# EasyEDA Pro project ProProject_IMUSensorNodes202312.epro, board 6_6_拼板20240123（不带编号） (continued)
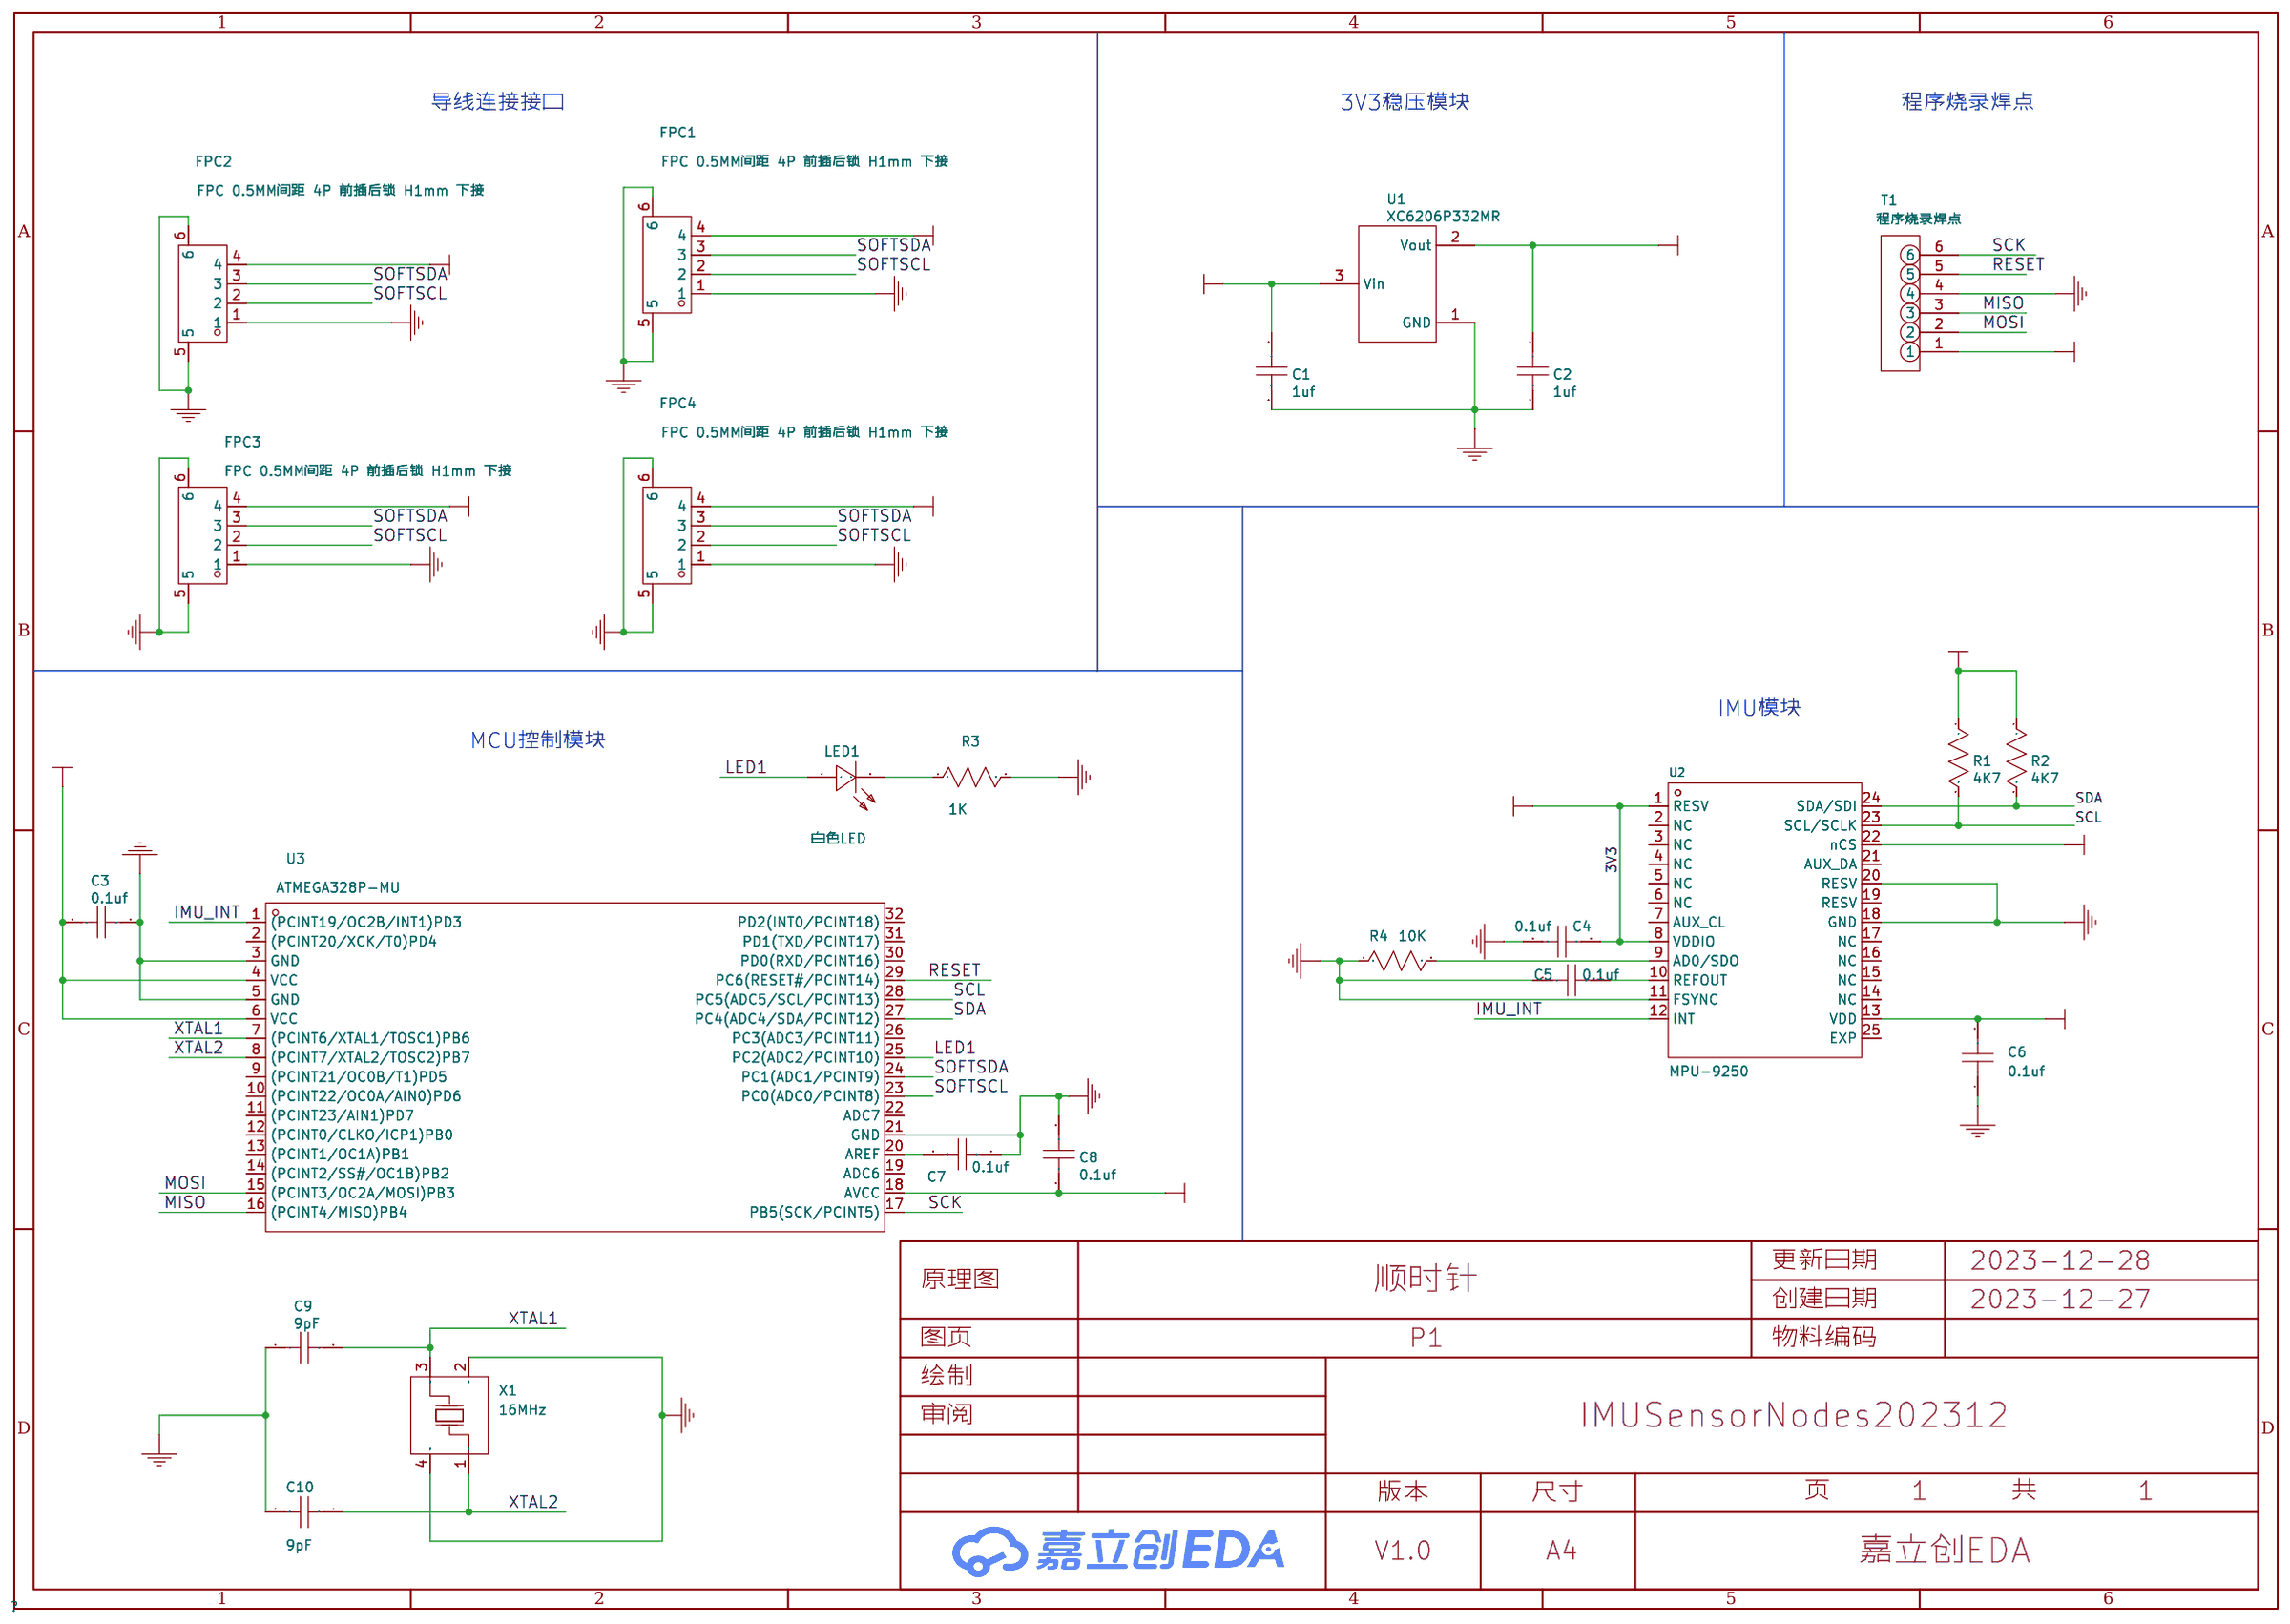
[diagram p0: schematic sheet]
## Placement (name value [footprint] x y rotation side) (continued)
FPC2#10  -  [fpc-0.5mm-4p-h1.0]  6 49.95 180 top
FPC2#11  -  [fpc-0.5mm-4p-h1.0]  60.61 77.38 180 top
FPC2#12  -  [fpc-0.5mm-4p-h1.0]  60.61 63.66 180 top
FPC2#13  -  [fpc-0.5mm-4p-h1.0]  6 36.23 180 top
FPC2#14  -  [fpc-0.5mm-4p-h1.0]  19.72 8.8 180 top
FPC2#15  -  [fpc-0.5mm-4p-h1.0]  74.33 8.8 180 top
FPC2#16  -  [fpc-0.5mm-4p-h1.0]  47.02 22.51 180 top
FPC2#17  -  [fpc-0.5mm-4p-h1.0]  19.72 36.23 180 top
FPC2#18  -  [fpc-0.5mm-4p-h1.0]  74.33 36.23 180 top
FPC2#19  -  [fpc-0.5mm-4p-h1.0]  6 63.66 180 top
FPC2#20  -  [fpc-0.5mm-4p-h1.0]  74.33 22.51 180 top
FPC2#21  -  [fpc-0.5mm-4p-h1.0]  33.31 36.23 180 top
FPC2#22  -  [fpc-0.5mm-4p-h1.0]  47.02 8.8 180 top
FPC2#23  -  [fpc-0.5mm-4p-h1.0]  33.31 77.38 180 top
FPC2#24  -  [fpc-0.5mm-4p-h1.0]  47.02 49.95 180 top
FPC2#25  -  [fpc-0.5mm-4p-h1.0]  60.61 49.95 180 top
FPC2#26  -  [fpc-0.5mm-4p-h1.0]  47.02 63.66 180 top
FPC2#27  -  [fpc-0.5mm-4p-h1.0]  47.02 36.23 180 top
FPC2#28  -  [fpc-0.5mm-4p-h1.0]  19.72 63.66 180 top
FPC2#29  -  [fpc-0.5mm-4p-h1.0]  19.72 49.95 180 top
FPC2#30  -  [fpc-0.5mm-4p-h1.0]  19.72 77.38 180 top
FPC2#31  -  [fpc-0.5mm-4p-h1.0]  74.33 63.66 180 top
FPC2#32  -  [fpc-0.5mm-4p-h1.0]  60.61 8.8 180 top
FPC2#33  -  [fpc-0.5mm-4p-h1.0]  33.31 22.51 180 top
FPC2#34  -  [fpc-0.5mm-4p-h1.0]  60.61 22.51 180 top
FPC2#35  -  [fpc-0.5mm-4p-h1.0]  33.31 63.66 180 top
FPC2#36  -  [fpc-0.5mm-4p-h1.0]  33.31 8.8 180 top
FPC3  -  [fpc-0.5mm-4p-h1.0#2]  36.1 33.43 90 top
FPC3#2  -  [fpc-0.5mm-4p-h1.0#2]  22.52 19.71 90 top
FPC3#3  -  [fpc-0.5mm-4p-h1.0#2]  77.13 19.71 90 top
FPC3#4  -  [fpc-0.5mm-4p-h1.0#2]  77.13 74.58 90 top
FPC3#5  -  [fpc-0.5mm-4p-h1.0#2]  63.41 6 90 top
FPC3#6  -  [fpc-0.5mm-4p-h1.0#2]  36.1 19.71 90 top
FPC3#7  -  [fpc-0.5mm-4p-h1.0#2]  22.52 33.43 90 top
FPC3#8  -  [fpc-0.5mm-4p-h1.0#2]  8.8 60.86 90 top
FPC3#9  -  [fpc-0.5mm-4p-h1.0#2]  49.82 33.43 90 top
FPC3#10  -  [fpc-0.5mm-4p-h1.0#2]  8.8 47.15 90 top
FPC3#11  -  [fpc-0.5mm-4p-h1.0#2]  77.13 60.86 90 top
FPC3#12  -  [fpc-0.5mm-4p-h1.0#2]  8.8 19.71 90 top
FPC3#13  -  [fpc-0.5mm-4p-h1.0#2]  63.41 19.71 90 top
FPC3#14  -  [fpc-0.5mm-4p-h1.0#2]  36.1 6 90 top
FPC3#15  -  [fpc-0.5mm-4p-h1.0#2]  8.8 6 90 top
FPC3#16  -  [fpc-0.5mm-4p-h1.0#2]  22.52 74.58 90 top
FPC3#17  -  [fpc-0.5mm-4p-h1.0#2]  36.1 60.86 90 top
FPC3#18  -  [fpc-0.5mm-4p-h1.0#2]  49.82 19.71 90 top
FPC3#19  -  [fpc-0.5mm-4p-h1.0#2]  22.52 60.86 90 top
FPC3#20  -  [fpc-0.5mm-4p-h1.0#2]  36.1 74.58 90 top
FPC3#21  -  [fpc-0.5mm-4p-h1.0#2]  49.82 74.58 90 top
FPC3#22  -  [fpc-0.5mm-4p-h1.0#2]  49.82 47.15 90 top
FPC3#23  -  [fpc-0.5mm-4p-h1.0#2]  77.13 33.43 90 top
FPC3#24  -  [fpc-0.5mm-4p-h1.0#2]  49.82 60.86 90 top
FPC3#25  -  [fpc-0.5mm-4p-h1.0#2]  63.41 74.58 90 top
FPC3#26  -  [fpc-0.5mm-4p-h1.0#2]  36.1 47.15 90 top
FPC3#27  -  [fpc-0.5mm-4p-h1.0#2]  8.8 33.43 90 top
FPC3#28  -  [fpc-0.5mm-4p-h1.0#2]  22.52 47.15 90 top
FPC3#29  -  [fpc-0.5mm-4p-h1.0#2]  22.52 6 90 top
FPC3#30  -  [fpc-0.5mm-4p-h1.0#2]  63.41 60.86 90 top
FPC3#31  -  [fpc-0.5mm-4p-h1.0#2]  63.41 33.43 90 top
FPC3#32  -  [fpc-0.5mm-4p-h1.0#2]  63.41 47.15 90 top
FPC3#33  -  [fpc-0.5mm-4p-h1.0#2]  77.13 47.15 90 top
FPC3#34  -  [fpc-0.5mm-4p-h1.0#2]  49.82 6 90 top
FPC3#35  -  [fpc-0.5mm-4p-h1.0#2]  77.13 6 90 top
FPC3#36  -  [fpc-0.5mm-4p-h1.0#2]  8.8 74.58 90 top
FPC4  -  [fpc-0.5mm-4p-h1.0]  60.61 16.91 0 top
FPC4#2  -  [fpc-0.5mm-4p-h1.0#3]  47.02 3.2 0 top
FPC4#3  -  [fpc-0.5mm-4p-h1.0]  33.31 58.06 0 top
FPC4#4  -  [fpc-0.5mm-4p-h1.0#3]  19.72 58.06 0 top
FPC4#5  -  [fpc-0.5mm-4p-h1.0#3]  74.33 3.2 0 top
FPC4#6  -  [fpc-0.5mm-4p-h1.0]  6 16.91 0 top
FPC4#7  -  [fpc-0.5mm-4p-h1.0]  6 3.2 0 top
FPC4#8  -  [fpc-0.5mm-4p-h1.0]  33.31 16.91 0 top
FPC4#9  -  [fpc-0.5mm-4p-h1.0#3]  74.33 58.06 0 top
FPC4#10  -  [fpc-0.5mm-4p-h1.0#3]  47.02 44.35 0 top
FPC4#11  -  [fpc-0.5mm-4p-h1.0]  6 58.06 0 top
FPC4#12  -  [fpc-0.5mm-4p-h1.0]  60.61 30.63 0 top
FPC4#13  -  [fpc-0.5mm-4p-h1.0]  6 71.78 0 top
FPC4#14  -  [fpc-0.5mm-4p-h1.0#3]  47.02 71.78 0 top
FPC4#15  -  [fpc-0.5mm-4p-h1.0#3]  19.72 30.63 0 top
FPC4#16  -  [fpc-0.5mm-4p-h1.0#3]  74.33 71.78 0 top
FPC4#17  -  [fpc-0.5mm-4p-h1.0]  33.31 3.2 0 top
FPC4#18  -  [fpc-0.5mm-4p-h1.0]  6 30.63 0 top
FPC4#19  -  [fpc-0.5mm-4p-h1.0]  33.31 30.63 0 top
FPC4#20  -  [fpc-0.5mm-4p-h1.0#3]  74.33 44.35 0 top
FPC4#21  -  [fpc-0.5mm-4p-h1.0#3]  47.02 58.06 0 top
FPC4#22  -  [fpc-0.5mm-4p-h1.0#3]  19.72 44.35 0 top
FPC4#23  -  [fpc-0.5mm-4p-h1.0]  33.31 44.35 0 top
FPC4#24  -  [fpc-0.5mm-4p-h1.0#3]  47.02 30.63 0 top
FPC4#25  -  [fpc-0.5mm-4p-h1.0]  60.61 71.78 0 top
FPC4#26  -  [fpc-0.5mm-4p-h1.0#3]  19.72 71.78 0 top
FPC4#27  -  [fpc-0.5mm-4p-h1.0]  60.61 3.2 0 top
FPC4#28  -  [fpc-0.5mm-4p-h1.0#3]  19.72 16.91 0 top
FPC4#29  -  [fpc-0.5mm-4p-h1.0#3]  74.33 30.63 0 top
FPC4#30  -  [fpc-0.5mm-4p-h1.0]  60.61 58.06 0 top
FPC4#31  -  [fpc-0.5mm-4p-h1.0#3]  74.33 16.91 0 top
FPC4#32  -  [fpc-0.5mm-4p-h1.0#3]  47.02 16.91 0 top
FPC4#33  -  [fpc-0.5mm-4p-h1.0]  60.61 44.35 0 top
FPC4#34  -  [fpc-0.5mm-4p-h1.0#3]  19.72 3.2 0 top
FPC4#35  -  [fpc-0.5mm-4p-h1.0]  6 44.35 0 top
FPC4#36  -  [fpc-0.5mm-4p-h1.0]  33.31 71.78 0 top
LED1  -  [LED0402]  15.4 30.25 90 top
LED1#2  -  [LED0402]  28.99 30.25 90 top
LED1#3  -  [LED0402]  42.7 30.25 90 top
LED1#4  -  [LED0402]  56.29 30.25 90 top
LED1#5  -  [LED0402]  70.01 30.25 90 top
LED1#6  -  [LED0402]  70.01 71.4 90 top
LED1#7  -  [LED0402]  1.68 16.54 90 top
LED1#8  -  [LED0402]  15.4 16.54 90 top
LED1#9  -  [LED0402]  28.99 16.54 90 top
LED1#10  -  [LED0402]  42.7 16.54 90 top
LED1#11  -  [LED0402]  56.29 16.54 90 top
LED1#12  -  [LED0402]  70.01 16.54 90 top
LED1#13  -  [LED0402]  1.68 2.82 90 top
LED1#14  -  [LED0402]  15.4 2.82 90 top
LED1#15  -  [LED0402]  28.99 2.82 90 top
LED1#16  -  [LED0402]  42.7 2.82 90 top
LED1#17  -  [LED0402]  56.29 2.82 90 top
LED1#18  -  [LED0402]  70.01 2.82 90 top
LED1#19  -  [LED0402]  1.68 71.4 90 top
LED1#20  -  [LED0402]  56.29 71.4 90 top
LED1#21  -  [LED0402]  15.4 71.4 90 top
LED1#22  -  [LED0402]  28.99 71.4 90 top
LED1#23  -  [LED0402]  42.7 71.4 90 top
LED1#24  -  [LED0402]  1.68 57.69 90 top
LED1#25  -  [LED0402]  15.4 57.69 90 top
LED1#26  -  [LED0402]  28.99 57.69 90 top
LED1#27  -  [LED0402]  42.7 57.69 90 top
LED1#28  -  [LED0402]  56.29 57.69 90 top
LED1#29  -  [LED0402]  70.01 57.69 90 top
LED1#30  -  [LED0402]  1.68 43.97 90 top
LED1#31  -  [LED0402]  15.4 43.97 90 top
LED1#32  -  [LED0402]  28.99 43.97 90 top
LED1#33  -  [LED0402]  42.7 43.97 90 top
LED1#34  -  [LED0402]  56.29 43.97 90 top
LED1#35  -  [LED0402]  70.01 43.97 90 top
LED1#36  -  [LED0402]  1.68 30.25 90 top
R1  -  [R0201]  15.78 37.24 0 bottom
R1#2  -  [R0201]  29.11 37.24 0 bottom
R1#3  -  [R0201]  43.08 37.24 0 bottom
R1#4  -  [R0201]  56.42 37.24 0 bottom
R1#5  -  [R0201]  70.39 37.24 0 bottom
R1#6  -  [R0201]  70.39 78.39 0 bottom
R1#7  -  [R0201]  1.81 23.52 0 bottom
R1#8  -  [R0201]  15.78 23.52 0 bottom
R1#9  -  [R0201]  29.11 23.52 0 bottom
R1#10  -  [R0201]  43.08 23.52 0 bottom
R1#11  -  [R0201]  56.42 23.52 0 bottom
R1#12  -  [R0201]  70.39 23.52 0 bottom
R1#13  -  [R0201]  1.81 9.81 0 bottom
R1#14  -  [R0201]  15.78 9.81 0 bottom
R1#15  -  [R0201]  29.11 9.81 0 bottom
R1#16  -  [R0201]  43.08 9.81 0 bottom
R1#17  -  [R0201]  56.42 9.81 0 bottom
R1#18  -  [R0201]  70.39 9.81 0 bottom
R1#19  -  [R0201]  1.81 78.39 0 bottom
R1#20  -  [R0201]  56.42 78.39 0 bottom
R1#21  -  [R0201]  15.78 78.39 0 bottom
R1#22  -  [R0201]  29.11 78.39 0 bottom
R1#23  -  [R0201]  43.08 78.39 0 bottom
R1#24  -  [R0201]  1.81 64.67 0 bottom
R1#25  -  [R0201]  15.78 64.67 0 bottom
R1#26  -  [R0201]  29.11 64.67 0 bottom
R1#27  -  [R0201]  43.08 64.67 0 bottom
R1#28  -  [R0201]  56.42 64.67 0 bottom
R1#29  -  [R0201]  70.39 64.67 0 bottom
R1#30  -  [R0201]  1.81 50.96 0 bottom
R1#31  -  [R0201]  15.78 50.96 0 bottom
R1#32  -  [R0201]  29.11 50.96 0 bottom
R1#33  -  [R0201]  43.08 50.96 0 bottom
R1#34  -  [R0201]  56.42 50.96 0 bottom
R1#35  -  [R0201]  70.39 50.96 0 bottom
R1#36  -  [R0201]  1.81 37.24 0 bottom
R2  -  [R0201]  15.78 38.26 0 bottom
R2#2  -  [R0201]  29.11 38.38 0 bottom
R2#3  -  [R0201]  43.08 38.26 0 bottom
R2#4  -  [R0201]  56.42 38.38 0 bottom
R2#5  -  [R0201]  70.39 38.26 0 bottom
R2#6  -  [R0201]  70.39 79.4 0 bottom
R2#7  -  [R0201]  1.81 24.67 0 bottom
R2#8  -  [R0201]  15.78 24.54 0 bottom
R2#9  -  [R0201]  29.11 24.67 0 bottom
R2#10  -  [R0201]  43.08 24.54 0 bottom
R2#11  -  [R0201]  56.42 24.67 0 bottom
R2#12  -  [R0201]  70.39 24.54 0 bottom
R2#13  -  [R0201]  1.81 10.95 0 bottom
R2#14  -  [R0201]  15.78 10.82 0 bottom
R2#15  -  [R0201]  29.11 10.95 0 bottom
R2#16  -  [R0201]  43.08 10.82 0 bottom
R2#17  -  [R0201]  56.42 10.95 0 bottom
R2#18  -  [R0201]  70.39 10.82 0 bottom
R2#19  -  [R0201]  1.81 79.53 0 bottom
R2#20  -  [R0201]  56.42 79.53 0 bottom
R2#21  -  [R0201]  15.78 79.4 0 bottom
R2#22  -  [R0201]  29.11 79.53 0 bottom
R2#23  -  [R0201]  43.08 79.4 0 bottom
R2#24  -  [R0201]  1.81 65.81 0 bottom
R2#25  -  [R0201]  15.78 65.69 0 bottom
R2#26  -  [R0201]  29.11 65.81 0 bottom
R2#27  -  [R0201]  43.08 65.69 0 bottom
R2#28  -  [R0201]  56.42 65.81 0 bottom
R2#29  -  [R0201]  70.39 65.69 0 bottom
R2#30  -  [R0201]  1.81 52.1 0 bottom
R2#31  -  [R0201]  15.78 51.97 0 bottom
R2#32  -  [R0201]  29.11 52.1 0 bottom
R2#33  -  [R0201]  43.08 51.97 0 bottom
R2#34  -  [R0201]  56.42 52.1 0 bottom
R2#35  -  [R0201]  70.39 51.97 0 bottom
R2#36  -  [R0201]  1.81 38.38 0 bottom
R3  -  [R0201]  14.51 30.38 270 top
R3#2  -  [R0201]  28.1 30.38 270 top
R3#3  -  [R0201]  41.81 30.38 270 top
R3#4  -  [R0201]  55.4 30.38 270 top
R3#5  -  [R0201]  69.12 30.38 270 top
R3#6  -  [R0201]  69.12 71.53 270 top
R3#7  -  [R0201]  0.79 16.67 270 top
R3#8  -  [R0201]  14.51 16.67 270 top
R3#9  -  [R0201]  28.1 16.67 270 top
R3#10  -  [R0201]  41.81 16.67 270 top
R3#11  -  [R0201]  55.4 16.67 270 top
R3#12  -  [R0201]  69.12 16.67 270 top
R3#13  -  [R0201]  0.79 2.95 270 top
R3#14  -  [R0201]  14.51 2.95 270 top
R3#15  -  [R0201]  28.1 2.95 270 top
R3#16  -  [R0201]  41.81 2.95 270 top
R3#17  -  [R0201]  55.4 2.95 270 top
R3#18  -  [R0201]  69.12 2.95 270 top
R3#19  -  [R0201]  0.79 71.53 270 top
R3#20  -  [R0201]  55.4 71.53 270 top
R3#21  -  [R0201]  14.51 71.53 270 top
R3#22  -  [R0201]  28.1 71.53 270 top
R3#23  -  [R0201]  41.81 71.53 270 top
R3#24  -  [R0201]  0.79 57.81 270 top
R3#25  -  [R0201]  14.51 57.81 270 top
R3#26  -  [R0201]  28.1 57.81 270 top
R3#27  -  [R0201]  41.81 57.81 270 top
R3#28  -  [R0201]  55.4 57.81 270 top
R3#29  -  [R0201]  69.12 57.81 270 top
R3#30  -  [R0201]  0.79 44.1 270 top
R3#31  -  [R0201]  14.51 44.1 270 top
R3#32  -  [R0201]  28.1 44.1 270 top
R3#33  -  [R0201]  41.81 44.1 270 top
R3#34  -  [R0201]  55.4 44.1 270 top
R3#35  -  [R0201]  69.12 44.1 270 top
R3#36  -  [R0201]  0.79 30.38 270 top
R4  -  [R0201]  75.6 23.78 180 bottom
R4#2  -  [R0201]  20.99 37.49 180 bottom
R4#3  -  [R0201]  34.7 37.49 180 bottom
R4#4  -  [R0201]  48.29 37.49 180 bottom
R4#5  -  [R0201]  62.01 37.49 180 bottom
R4#6  -  [R0201]  75.6 37.49 180 bottom
R4#7  -  [R0201]  75.6 78.64 180 bottom
R4#8  -  [R0201]  7.4 23.78 180 bottom
R4#9  -  [R0201]  20.99 23.78 180 bottom
R4#10  -  [R0201]  34.7 23.78 180 bottom
R4#11  -  [R0201]  48.29 23.78 180 bottom
R4#12  -  [R0201]  62.01 23.78 180 bottom
R4#13  -  [R0201]  7.4 10.06 180 bottom
R4#14  -  [R0201]  20.99 10.06 180 bottom
R4#15  -  [R0201]  34.7 10.06 180 bottom
R4#16  -  [R0201]  48.29 10.06 180 bottom
R4#17  -  [R0201]  62.01 10.06 180 bottom
R4#18  -  [R0201]  75.6 10.06 180 bottom
R4#19  -  [R0201]  7.4 78.64 180 bottom
R4#20  -  [R0201]  62.01 78.64 180 bottom
R4#21  -  [R0201]  20.99 78.64 180 bottom
R4#22  -  [R0201]  34.7 78.64 180 bottom
R4#23  -  [R0201]  48.29 78.64 180 bottom
R4#24  -  [R0201]  7.4 64.93 180 bottom
R4#25  -  [R0201]  20.99 64.93 180 bottom
R4#26  -  [R0201]  34.7 64.93 180 bottom
R4#27  -  [R0201]  48.29 64.93 180 bottom
R4#28  -  [R0201]  62.01 64.93 180 bottom
R4#29  -  [R0201]  75.6 64.93 180 bottom
R4#30  -  [R0201]  7.4 51.21 180 bottom
R4#31  -  [R0201]  20.99 51.21 180 bottom
R4#32  -  [R0201]  34.7 51.21 180 bottom
R4#33  -  [R0201]  48.29 51.21 180 bottom
R4#34  -  [R0201]  62.01 51.21 180 bottom
R4#35  -  [R0201]  75.6 51.21 180 bottom
R4#36  -  [R0201]  7.4 37.49 180 bottom
T1  -  [test]  77.73 59.26 270 bottom
T1#2  -  [test]  77.73 45.54 270 bottom
T1#3  -  [test]  23.12 72.98 270 bottom
T1#4  -  [test]  9.4 72.98 270 bottom
T1#5  -  [test]  64.01 31.83 270 bottom
T1#6  -  [test]  50.42 4.4 270 bottom
T1#7  -  [test]  36.71 31.83 270 bottom
T1#8  -  [test]  50.42 31.83 270 bottom
T1#9  -  [test]  9.4 45.54 270 bottom
T1#10  -  [test]  77.73 31.83 270 bottom
T1#11  -  [test]  50.42 72.98 270 bottom
T1#12  -  [test]  23.12 45.54 270 bottom
T1#13  -  [test]  23.12 31.83 270 bottom
T1#14  -  [test]  23.12 4.4 270 bottom
T1#15  -  [test]  64.01 59.26 270 bottom
T1#16  -  [test]  64.01 18.11 270 bottom
T1#17  -  [test]  50.42 18.11 270 bottom
T1#18  -  [test]  64.01 72.98 270 bottom
T1#19  -  [test]  36.71 45.54 270 bottom
T1#20  -  [test]  36.71 18.11 270 bottom
T1#21  -  [test]  36.71 59.26 270 bottom
T1#22  -  [test]  9.4 31.83 270 bottom
T1#23  -  [test]  50.42 45.54 270 bottom
T1#24  -  [test]  77.73 4.4 270 bottom
T1#25  -  [test]  9.4 4.4 270 bottom
T1#26  -  [test]  77.73 18.11 270 bottom
T1#27  -  [test]  64.01 4.4 270 bottom
T1#28  -  [test]  36.71 4.4 270 bottom
T1#29  -  [test]  50.42 59.26 270 bottom
T1#30  -  [test]  23.12 18.11 270 bottom
T1#31  -  [test]  9.4 18.11 270 bottom
T1#32  -  [test]  64.01 45.54 270 bottom
T1#33  -  [test]  23.12 59.26 270 bottom
T1#34  -  [test]  9.4 59.26 270 bottom
T1#35  -  [test]  77.73 72.98 270 bottom
T1#36  -  [test]  36.71 72.98 270 bottom
U1  -  [SOT-23-3_L2.9-W1.6-P1.90-LS2.8-BR]  23.4 34.95 0 bottom
U1#2  -  [SOT-23-3_L2.9-W1.6-P1.90-LS2.8-BR]  37.12 34.95 0 bottom
U1#3  -  [SOT-23-3_L2.9-W1.6-P1.90-LS2.8-BR]  50.7 34.95 0 bottom
U1#4  -  [SOT-23-3_L2.9-W1.6-P1.90-LS2.8-BR]  64.42 34.95 0 bottom
U1#5  -  [SOT-23-3_L2.9-W1.6-P1.90-LS2.8-BR]  78.01 34.95 0 bottom
U1#6  -  [SOT-23-3_L2.9-W1.6-P1.90-LS2.8-BR]  78.01 76.1 0 bottom
U1#7  -  [SOT-23-3_L2.9-W1.6-P1.90-LS2.8-BR]  9.81 21.24 0 bottom
U1#8  -  [SOT-23-3_L2.9-W1.6-P1.90-LS2.8-BR]  23.4 21.24 0 bottom
U1#9  -  [SOT-23-3_L2.9-W1.6-P1.90-LS2.8-BR]  37.12 21.24 0 bottom
U1#10  -  [SOT-23-3_L2.9-W1.6-P1.90-LS2.8-BR]  50.7 21.24 0 bottom
U1#11  -  [SOT-23-3_L2.9-W1.6-P1.90-LS2.8-BR]  64.42 21.24 0 bottom
U1#12  -  [SOT-23-3_L2.9-W1.6-P1.90-LS2.8-BR]  78.01 21.24 0 bottom
U1#13  -  [SOT-23-3_L2.9-W1.6-P1.90-LS2.8-BR]  9.81 7.52 0 bottom
U1#14  -  [SOT-23-3_L2.9-W1.6-P1.90-LS2.8-BR]  23.4 7.52 0 bottom
U1#15  -  [SOT-23-3_L2.9-W1.6-P1.90-LS2.8-BR]  37.12 7.52 0 bottom
U1#16  -  [SOT-23-3_L2.9-W1.6-P1.90-LS2.8-BR]  50.7 7.52 0 bottom
U1#17  -  [SOT-23-3_L2.9-W1.6-P1.90-LS2.8-BR]  64.42 7.52 0 bottom
U1#18  -  [SOT-23-3_L2.9-W1.6-P1.90-LS2.8-BR]  78.01 7.52 0 bottom
U1#19  -  [SOT-23-3_L2.9-W1.6-P1.90-LS2.8-BR]  9.81 76.1 0 bottom
U1#20  -  [SOT-23-3_L2.9-W1.6-P1.90-LS2.8-BR]  64.42 76.1 0 bottom
U1#21  -  [SOT-23-3_L2.9-W1.6-P1.90-LS2.8-BR]  23.4 76.1 0 bottom
U1#22  -  [SOT-23-3_L2.9-W1.6-P1.90-LS2.8-BR]  37.12 76.1 0 bottom
U1#23  -  [SOT-23-3_L2.9-W1.6-P1.90-LS2.8-BR]  50.7 76.1 0 bottom
U1#24  -  [SOT-23-3_L2.9-W1.6-P1.90-LS2.8-BR]  9.81 62.39 0 bottom
U1#25  -  [SOT-23-3_L2.9-W1.6-P1.90-LS2.8-BR]  23.4 62.39 0 bottom
U1#26  -  [SOT-23-3_L2.9-W1.6-P1.90-LS2.8-BR]  37.12 62.39 0 bottom
U1#27  -  [SOT-23-3_L2.9-W1.6-P1.90-LS2.8-BR]  50.7 62.39 0 bottom
U1#28  -  [SOT-23-3_L2.9-W1.6-P1.90-LS2.8-BR]  64.42 62.39 0 bottom
U1#29  -  [SOT-23-3_L2.9-W1.6-P1.90-LS2.8-BR]  78.01 62.39 0 bottom
U1#30  -  [SOT-23-3_L2.9-W1.6-P1.90-LS2.8-BR]  9.81 48.67 0 bottom
U1#31  -  [SOT-23-3_L2.9-W1.6-P1.90-LS2.8-BR]  23.4 48.67 0 bottom
U1#32  -  [SOT-23-3_L2.9-W1.6-P1.90-LS2.8-BR]  37.12 48.67 0 bottom
U1#33  -  [SOT-23-3_L2.9-W1.6-P1.90-LS2.8-BR]  50.7 48.67 0 bottom
U1#34  -  [SOT-23-3_L2.9-W1.6-P1.90-LS2.8-BR]  64.42 48.67 0 bottom
U1#35  -  [SOT-23-3_L2.9-W1.6-P1.90-LS2.8-BR]  78.01 48.67 0 bottom
U1#36  -  [SOT-23-3_L2.9-W1.6-P1.90-LS2.8-BR]  9.81 34.95 0 bottom
U2  -  [qfn-24_l3.0-w3.0-p0.40-bl-ep]  4.6 78.01 0 bottom
U2#2  -  [qfn-24_l3.0-w3.0-p0.40-bl-ep#2]  45.62 23.14 0 bottom
U2#3  -  [qfn-24_l3.0-w3.0-p0.40-bl-ep#2]  45.62 36.86 0 bottom
U2#4  -  [qfn-24_l3.0-w3.0-p0.40-bl-ep]  4.6 36.86 0 bottom
U2#5  -  [qfn-24_l3.0-w3.0-p0.40-bl-ep#2]  45.62 50.58 0 bottom
U2#6  -  [qfn-24_l3.0-w3.0-p0.40-bl-ep#2]  72.93 50.58 0 bottom
U2#7  -  [qfn-24_l3.0-w3.0-p0.40-bl-ep#2]  18.32 78.01 0 bottom
U2#8  -  [qfn-24_l3.0-w3.0-p0.40-bl-ep]  31.91 36.86 0 bottom
U2#9  -  [qfn-24_l3.0-w3.0-p0.40-bl-ep]  31.91 23.14 0 bottom
U2#10  -  [qfn-24_l3.0-w3.0-p0.40-bl-ep]  59.21 36.86 0 bottom
U2#11  -  [qfn-24_l3.0-w3.0-p0.40-bl-ep]  4.6 9.43 0 bottom
U2#12  -  [qfn-24_l3.0-w3.0-p0.40-bl-ep#2]  18.32 64.29 0 bottom
U2#13  -  [qfn-24_l3.0-w3.0-p0.40-bl-ep]  59.21 64.29 0 bottom
U2#14  -  [qfn-24_l3.0-w3.0-p0.40-bl-ep#2]  18.32 50.58 0 bottom
U2#15  -  [qfn-24_l3.0-w3.0-p0.40-bl-ep]  59.21 78.01 0 bottom
U2#16  -  [qfn-24_l3.0-w3.0-p0.40-bl-ep#2]  72.93 36.86 0 bottom
U2#17  -  [qfn-24_l3.0-w3.0-p0.40-bl-ep]  59.21 23.14 0 bottom
U2#18  -  [qfn-24_l3.0-w3.0-p0.40-bl-ep#2]  18.32 9.43 0 bottom
U2#19  -  [qfn-24_l3.0-w3.0-p0.40-bl-ep#2]  45.62 9.43 0 bottom
U2#20  -  [qfn-24_l3.0-w3.0-p0.40-bl-ep#2]  72.93 9.43 0 bottom
U2#21  -  [qfn-24_l3.0-w3.0-p0.40-bl-ep]  31.91 50.58 0 bottom
U2#22  -  [qfn-24_l3.0-w3.0-p0.40-bl-ep#2]  18.32 23.14 0 bottom
U2#23  -  [qfn-24_l3.0-w3.0-p0.40-bl-ep]  59.21 9.43 0 bottom
U2#24  -  [qfn-24_l3.0-w3.0-p0.40-bl-ep#2]  45.62 78.01 0 bottom
U2#25  -  [qfn-24_l3.0-w3.0-p0.40-bl-ep]  31.91 9.43 0 bottom
U2#26  -  [qfn-24_l3.0-w3.0-p0.40-bl-ep]  59.21 50.58 0 bottom
U2#27  -  [qfn-24_l3.0-w3.0-p0.40-bl-ep]  31.91 78.01 0 bottom
U2#28  -  [qfn-24_l3.0-w3.0-p0.40-bl-ep#2]  18.32 36.86 0 bottom
U2#29  -  [qfn-24_l3.0-w3.0-p0.40-bl-ep]  4.6 64.29 0 bottom
U2#30  -  [qfn-24_l3.0-w3.0-p0.40-bl-ep]  4.6 50.58 0 bottom
U2#31  -  [qfn-24_l3.0-w3.0-p0.40-bl-ep]  31.91 64.29 0 bottom
U2#32  -  [qfn-24_l3.0-w3.0-p0.40-bl-ep#2]  72.93 64.29 0 bottom
U2#33  -  [qfn-24_l3.0-w3.0-p0.40-bl-ep]  4.6 23.14 0 bottom
U2#34  -  [qfn-24_l3.0-w3.0-p0.40-bl-ep#2]  45.62 64.29 0 bottom
U2#35  -  [qfn-24_l3.0-w3.0-p0.40-bl-ep#2]  72.93 23.14 0 bottom
U2#36  -  [qfn-24_l3.0-w3.0-p0.40-bl-ep#2]  72.93 78.01 0 bottom
U3  -  [邮票孔]  26.68 33.57 0 top
U3#2  -  [邮票孔]  40.32 33.56 0 top
U3#3  -  [邮票孔]  53.98 33.57 0 top
U3#4  -  [邮票孔]  67.64 33.43 0 top
U3#5  -  [邮票孔]  5.87 26.73 90 top
U3#6  -  [邮票孔]  74.08 26.73 90 top
U3#7  -  [邮票孔]  60.4 26.73 90 top
U3#8  -  [邮票孔]  33.1 26.73 90 top
U3#9  -  [邮票孔]  19.47 26.73 90 top
U3#10  -  [邮票孔]  46.78 26.73 90 top
U3#11  -  [邮票孔]  5.87 67.88 90 top
U3#12  -  [邮票孔]  19.47 67.88 90 top
U3#13  -  [邮票孔]  33.1 67.88 90 top
U3#14  -  [邮票孔]  46.78 67.88 90 top
U3#15  -  [邮票孔]  60.4 67.88 90 top
U3#16  -  [邮票孔]  74.08 67.88 90 top
U3#17  -  [邮票孔]  13.02 19.71 0 top
U3#18  -  [邮票孔]  26.68 19.85 0 top
U3#19  -  [邮票孔]  40.32 19.84 0 top
U3#20  -  [邮票孔]  53.98 19.85 0 top
U3#21  -  [邮票孔]  67.64 19.71 0 top
U3#22  -  [邮票孔]  5.87 13.02 90 top
U3#23  -  [邮票孔]  74.08 13.02 90 top
U3#24  -  [邮票孔]  60.4 13.02 90 top
U3#25  -  [邮票孔]  33.1 13.02 90 top
U3#26  -  [邮票孔]  19.47 13.02 90 top
U3#27  -  [邮票孔]  46.78 13.02 90 top
U3#28  -  [邮票孔]  13.02 6 0 top
U3#29  -  [邮票孔]  13.02 74.58 0 top
U3#30  -  [邮票孔]  26.68 6.14 0 top
U3#31  -  [邮票孔]  40.32 6.13 0 top
U3#32  -  [邮票孔]  53.98 6.14 0 top
U3#33  -  [邮票孔]  67.64 6 0 top
U3#34  -  [邮票孔]  53.98 74.72 0 top
U3#35  -  [邮票孔]  67.64 74.58 0 top
U3#36  -  [邮票孔]  26.68 74.72 0 top
U3#37  -  [邮票孔]  40.32 74.71 0 top
U3#38  -  [邮票孔]  13.02 60.86 0 top
U3#39  -  [邮票孔]  26.68 61 0 top
U3#40  -  [邮票孔]  40.32 60.99 0 top
U3#41  -  [邮票孔]  53.98 61 0 top
U3#42  -  [邮票孔]  67.64 60.86 0 top
U3#43  -  [邮票孔]  5.87 54.17 90 top
U3#44  -  [邮票孔]  74.08 54.17 90 top
U3#45  -  [邮票孔]  60.4 54.17 90 top
U3#46  -  [邮票孔]  33.1 54.17 90 top
U3#47  -  [邮票孔]  19.47 54.17 90 top
U3#48  -  [邮票孔]  46.78 54.17 90 top
U3#49  -  [邮票孔]  13.02 47.15 0 top
U3#50  -  [邮票孔]  26.68 47.29 0 top
U3#51  -  [邮票孔]  40.32 47.28 0 top
U3#52  -  [邮票孔]  53.98 47.29 0 top
U3#53  -  [邮票孔]  67.64 47.15 0 top
U3#54  -  [邮票孔]  5.87 40.45 90 top
U3#55  -  [邮票孔]  74.08 40.45 90 top
U3#56  -  [邮票孔]  60.4 40.45 90 top
U3#57  -  [邮票孔]  33.1 40.45 90 top
U3#58  -  [邮票孔]  19.47 40.45 90 top
U3#59  -  [邮票孔]  46.78 40.45 90 top
U3#60  -  [邮票孔]  13.02 33.43 0 top
U3#61  -  [vqfn-32_l5.0-w5.0-p0.50-tl-ep3.1]  72.67 58.83 270 bottom
U3#62  -  [vqfn-32_l5.0-w5.0-p0.50-tl-ep3.1]  45.37 17.68 270 bottom
U3#63  -  [vqfn-32_l5.0-w5.0-p0.50-tl-ep3.1#2]  58.96 58.83 270 bottom
U3#64  -  [vqfn-32_l5.0-w5.0-p0.50-tl-ep3.1]  45.37 45.11 270 bottom
U3#65  -  [vqfn-32_l5.0-w5.0-p0.50-tl-ep3.1#2]  4.35 31.4 270 bottom
U3#66  -  [vqfn-32_l5.0-w5.0-p0.50-tl-ep3.1#2]  58.96 72.55 270 bottom
U3#67  -  [vqfn-32_l5.0-w5.0-p0.50-tl-ep3.1]  72.67 45.11 270 bottom
U3#68  -  [vqfn-32_l5.0-w5.0-p0.50-tl-ep3.1#2]  4.35 45.11 270 bottom
U3#69  -  [vqfn-32_l5.0-w5.0-p0.50-tl-ep3.1]  45.37 72.55 270 bottom
U3#70  -  [vqfn-32_l5.0-w5.0-p0.50-tl-ep3.1#2]  31.65 31.4 270 bottom
U3#71  -  [vqfn-32_l5.0-w5.0-p0.50-tl-ep3.1]  18.06 72.55 270 bottom
U3#72  -  [vqfn-32_l5.0-w5.0-p0.50-tl-ep3.1#2]  4.35 17.68 270 bottom
U3#73  -  [vqfn-32_l5.0-w5.0-p0.50-tl-ep3.1#2]  31.65 17.68 270 bottom
U3#74  -  [vqfn-32_l5.0-w5.0-p0.50-tl-ep3.1#2]  4.35 58.83 270 bottom
U3#75  -  [vqfn-32_l5.0-w5.0-p0.50-tl-ep3.1#2]  31.65 45.11 270 bottom
U3#76  -  [vqfn-32_l5.0-w5.0-p0.50-tl-ep3.1#2]  31.65 58.83 270 bottom
U3#77  -  [vqfn-32_l5.0-w5.0-p0.50-tl-ep3.1#2]  31.65 72.55 270 bottom
U3#78  -  [vqfn-32_l5.0-w5.0-p0.50-tl-ep3.1]  45.37 58.83 270 bottom
U3#79  -  [vqfn-32_l5.0-w5.0-p0.50-tl-ep3.1]  45.37 31.4 270 bottom
U3#80  -  [vqfn-32_l5.0-w5.0-p0.50-tl-ep3.1]  72.67 3.97 270 bottom
U3#81  -  [vqfn-32_l5.0-w5.0-p0.50-tl-ep3.1]  18.06 31.4 270 bottom
U3#82  -  [vqfn-32_l5.0-w5.0-p0.50-tl-ep3.1#2]  58.96 31.4 270 bottom
U3#83  -  [vqfn-32_l5.0-w5.0-p0.50-tl-ep3.1]  72.67 72.55 270 bottom
U3#84  -  [vqfn-32_l5.0-w5.0-p0.50-tl-ep3.1]  18.06 45.11 270 bottom
U3#85  -  [vqfn-32_l5.0-w5.0-p0.50-tl-ep3.1#2]  58.96 3.97 270 bottom
U3#86  -  [vqfn-32_l5.0-w5.0-p0.50-tl-ep3.1]  45.37 3.97 270 bottom
U3#87  -  [vqfn-32_l5.0-w5.0-p0.50-tl-ep3.1]  72.67 31.4 270 bottom
U3#88  -  [vqfn-32_l5.0-w5.0-p0.50-tl-ep3.1]  18.06 58.83 270 bottom
U3#89  -  [vqfn-32_l5.0-w5.0-p0.50-tl-ep3.1#2]  58.96 45.11 270 bottom
U3#90  -  [vqfn-32_l5.0-w5.0-p0.50-tl-ep3.1]  18.06 3.97 270 bottom
U3#91  -  [vqfn-32_l5.0-w5.0-p0.50-tl-ep3.1#2]  4.35 3.97 270 bottom
U3#92  -  [vqfn-32_l5.0-w5.0-p0.50-tl-ep3.1#2]  31.65 3.97 270 bottom
U3#93  -  [vqfn-32_l5.0-w5.0-p0.50-tl-ep3.1#2]  58.96 17.68 270 bottom
U3#94  -  [vqfn-32_l5.0-w5.0-p0.50-tl-ep3.1]  72.67 17.68 270 bottom
U3#95  -  [vqfn-32_l5.0-w5.0-p0.50-tl-ep3.1]  18.06 17.68 270 bottom
U3#96  -  [vqfn-32_l5.0-w5.0-p0.50-tl-ep3.1#2]  4.35 72.55 270 bottom
X1  -  [CRYSTAL-SMD_4P-L1.6-W1.2-BL]  64.17 23.91 90 top
X1#2  -  [CRYSTAL-SMD_4P-L1.6-W1.2-BL]  77.88 23.91 90 top
X1#3  -  [CRYSTAL-SMD_4P-L1.6-W1.2-BL]  9.56 37.62 90 top
X1#4  -  [CRYSTAL-SMD_4P-L1.6-W1.2-BL]  23.27 37.62 90 top
X1#5  -  [CRYSTAL-SMD_4P-L1.6-W1.2-BL]  36.86 37.62 90 top
X1#6  -  [CRYSTAL-SMD_4P-L1.6-W1.2-BL]  50.58 37.62 90 top
X1#7  -  [CRYSTAL-SMD_4P-L1.6-W1.2-BL]  64.17 37.62 90 top
X1#8  -  [CRYSTAL-SMD_4P-L1.6-W1.2-BL]  77.88 37.62 90 top
X1#9  -  [CRYSTAL-SMD_4P-L1.6-W1.2-BL]  77.88 78.77 90 top
X1#10  -  [CRYSTAL-SMD_4P-L1.6-W1.2-BL]  9.56 23.91 90 top
X1#11  -  [CRYSTAL-SMD_4P-L1.6-W1.2-BL]  23.27 23.91 90 top
X1#12  -  [CRYSTAL-SMD_4P-L1.6-W1.2-BL]  36.86 23.91 90 top
X1#13  -  [CRYSTAL-SMD_4P-L1.6-W1.2-BL]  50.58 23.91 90 top
X1#14  -  [CRYSTAL-SMD_4P-L1.6-W1.2-BL]  9.56 10.19 90 top
X1#15  -  [CRYSTAL-SMD_4P-L1.6-W1.2-BL]  23.27 10.19 90 top
X1#16  -  [CRYSTAL-SMD_4P-L1.6-W1.2-BL]  36.86 10.19 90 top
X1#17  -  [CRYSTAL-SMD_4P-L1.6-W1.2-BL]  50.58 10.19 90 top
X1#18  -  [CRYSTAL-SMD_4P-L1.6-W1.2-BL]  64.17 10.19 90 top
X1#19  -  [CRYSTAL-SMD_4P-L1.6-W1.2-BL]  77.88 10.19 90 top
X1#20  -  [CRYSTAL-SMD_4P-L1.6-W1.2-BL]  9.56 78.77 90 top
X1#21  -  [CRYSTAL-SMD_4P-L1.6-W1.2-BL]  64.17 78.77 90 top
X1#22  -  [CRYSTAL-SMD_4P-L1.6-W1.2-BL]  23.27 78.77 90 top
X1#23  -  [CRYSTAL-SMD_4P-L1.6-W1.2-BL]  36.86 78.77 90 top
X1#24  -  [CRYSTAL-SMD_4P-L1.6-W1.2-BL]  50.58 78.77 90 top
X1#25  -  [CRYSTAL-SMD_4P-L1.6-W1.2-BL]  9.56 65.05 90 top
X1#26  -  [CRYSTAL-SMD_4P-L1.6-W1.2-BL]  23.27 65.05 90 top
X1#27  -  [CRYSTAL-SMD_4P-L1.6-W1.2-BL]  36.86 65.05 90 top
X1#28  -  [CRYSTAL-SMD_4P-L1.6-W1.2-BL]  50.58 65.05 90 top
X1#29  -  [CRYSTAL-SMD_4P-L1.6-W1.2-BL]  64.17 65.05 90 top
X1#30  -  [CRYSTAL-SMD_4P-L1.6-W1.2-BL]  77.88 65.05 90 top
X1#31  -  [CRYSTAL-SMD_4P-L1.6-W1.2-BL]  9.56 51.34 90 top
X1#32  -  [CRYSTAL-SMD_4P-L1.6-W1.2-BL]  23.27 51.34 90 top
X1#33  -  [CRYSTAL-SMD_4P-L1.6-W1.2-BL]  36.86 51.34 90 top
X1#34  -  [CRYSTAL-SMD_4P-L1.6-W1.2-BL]  50.58 51.34 90 top
X1#35  -  [CRYSTAL-SMD_4P-L1.6-W1.2-BL]  64.17 51.34 90 top
X1#36  -  [CRYSTAL-SMD_4P-L1.6-W1.2-BL]  77.88 51.34 90 top

## Footprints (pads in the part's own frame, mm; a bottom-side part is the same pattern mirrored in y, then rotated)
C0201
  rect 0.28x0.318 smd: 1(-0.28,0) 2(0.28,0)
CRYSTAL-SMD_4P-L1.6-W1.2-BL
  rect 0.73x0.6 smd: 1(-0.55,-0.4) 2(0.55,-0.4) 3(0.55,0.4) 4(-0.55,0.4)
fpc-0.5mm-4p-h1.0
  rect 0.3x1 smd: 1(-0.75,0) 2(-0.251,0) 3(0.249,0) 4(0.75,0)
  rect 1.2x0.8 smd: 5(-1.81,-2.286) 6(1.794,-2.286)
fpc-0.5mm-4p-h1.0#2
  rect 0.3x1 smd: 1(-0.75,0) 2(-0.251,0) 3(0.249,0) 4(0.75,0)
  rect 1x0.8 smd: 5(-1.81,-2.286)
  rect 1.2x0.8 smd: 6(1.794,-2.286)
fpc-0.5mm-4p-h1.0#3
  rect 0.3x1 smd: 1(-0.75,0) 2(-0.251,0) 3(0.249,0) 4(0.75,0)
  rect 0.8x0.8 smd: 5(-1.81,-2.286) 6(1.794,-2.286)
LED0402
  rect 0.4x0.55 smd: 1(-0.45,0) 2(0.45,0)
qfn-24_l3.0-w3.0-p0.40-bl-ep
  custom 0.2x0.506 smd: 1(-1,-1.427) 6(1,-1.427) 13(1,1.427) 18(-1,1.427)
  rect 0.2x0.505 smd: 2(-0.6,-1.427) 3(-0.2,-1.427) 4(0.2,-1.427) 5(0.6,-1.427) 14(0.6,1.427) 15(0.2,1.427) 16(-0.2,1.427) 17(-0.6,1.427)
  rect 0.505x0.2 smd: 8(1.427,-0.6) 9(1.427,-0.2) 10(1.427,0.2) 11(1.427,0.6) 20(-1.427,0.6) 21(-1.427,0.2) 22(-1.427,-0.2) 23(-1.427,-0.6)
  custom 0.506x0.2 smd: 12(1.427,1) 19(-1.427,1) 24(-1.427,-1)
  rect 1.7x1.7 smd: 25(0,0)
qfn-24_l3.0-w3.0-p0.40-bl-ep#2
  custom 0.2x0.506 smd: 1(-1,-1.427) 6(1,-1.427) 13(1,1.427) 18(-1,1.427)
  rect 0.2x0.505 smd: 2(-0.6,-1.427) 3(-0.2,-1.427) 4(0.2,-1.427) 5(0.6,-1.427) 14(0.6,1.427) 15(0.2,1.427) 16(-0.2,1.427) 17(-0.6,1.427)
  rect 0.003x0.003 smd: 7(1.425,-0.997)
  rect 0.505x0.2 smd: 8(1.427,-0.6) 9(1.427,-0.2) 10(1.427,0.2) 11(1.427,0.6) 20(-1.427,0.6) 21(-1.427,0.2) 22(-1.427,-0.2) 23(-1.427,-0.6)
  custom 0.506x0.2 smd: 12(1.427,1) 19(-1.427,1) 24(-1.427,-1)
  rect 1.7x1.7 smd: 25(0,0)
R0201
  rect 0.28x0.318 smd: 1(-0.28,0) 2(0.28,0)
SOT-23-3_L2.9-W1.6-P1.90-LS2.8-BR
  rect 1.07x0.532 smd: 1(1.135,-0.95) 2(1.135,0.95) 3(-1.135,0)
test
  round 0.6 smd: 1(0,0) 2(1.27,0) 3(2.54,0) 4(0,-1.27) 5(1.27,-1.27) 6(2.54,-1.27)
vqfn-32_l5.0-w5.0-p0.50-tl-ep3.1
  rect 0.665x0.28 smd: 1(-2.408,1.75) 2(-2.408,1.25) 3(-2.408,0.75) 4(-2.408,0.25) 5(-2.408,-0.25) 6(-2.408,-0.75) 7(-2.408,-1.25) 8(-2.408,-1.75) 17(2.408,-1.75) 18(2.408,-1.25) 19(2.408,-0.75) 20(2.408,-0.25) 21(2.408,0.25) 23(2.408,1.25) 24(2.408,1.75)
  rect 0.28x0.665 smd: 9(-1.75,-2.408) 10(-1.25,-2.408) 11(-0.75,-2.408) 12(-0.25,-2.408) 14(0.75,-2.408) 15(1.25,-2.408) 16(1.75,-2.408) 25(1.75,2.408) 27(0.75,2.408) 28(0.25,2.408) 29(-0.25,2.408) 31(-1.25,2.408) 32(-1.75,2.408)
  rect 3.1x3.1 smd: 33(0,0)
vqfn-32_l5.0-w5.0-p0.50-tl-ep3.1#2
  rect 0.665x0.28 smd: 1(-2.408,1.75) 2(-2.408,1.25) 3(-2.408,0.75) 4(-2.408,0.25) 5(-2.408,-0.25) 6(-2.408,-0.75) 7(-2.408,-1.25) 8(-2.408,-1.75) 17(2.408,-1.75) 18(2.408,-1.25) 19(2.408,-0.75) 20(2.408,-0.25) 21(2.408,0.25) 23(2.408,1.25) 24(2.408,1.75)
  rect 0.28x0.665 smd: 10(-1.25,-2.408) 11(-0.75,-2.408) 12(-0.25,-2.408) 13(0.254,-2.413) 15(1.25,-2.408) 16(1.75,-2.408) 25(1.75,2.408) 27(0.75,2.408) 28(0.25,2.408) 29(-0.25,2.408) 32(-1.75,2.408)
  rect 0.003x0.003 smd: 13(0.25,-2.408)
  rect 3.1x3.1 smd: 33(0,0)
邮票孔
  round 0.3 hole 0.315x0.3: 1(0.508,2.54) 2(0.508,1.79) 3(0.508,1.04) 4(0.508,0.29) 5(0.508,-0.46) 6(0.508,-1.21) 7(0.508,-1.96) 8(0.508,-2.71) 9(-0.892,2.54) 10(-0.892,1.79) 11(-0.892,1.04) 12(-0.892,0.29) 13(-0.892,-0.46) 14(-0.892,-1.21) 15(-0.892,-1.96) 16(-0.892,-2.71)

## Nets
